# EasyEDA Pro project Chessboards.epro, board Diagonal
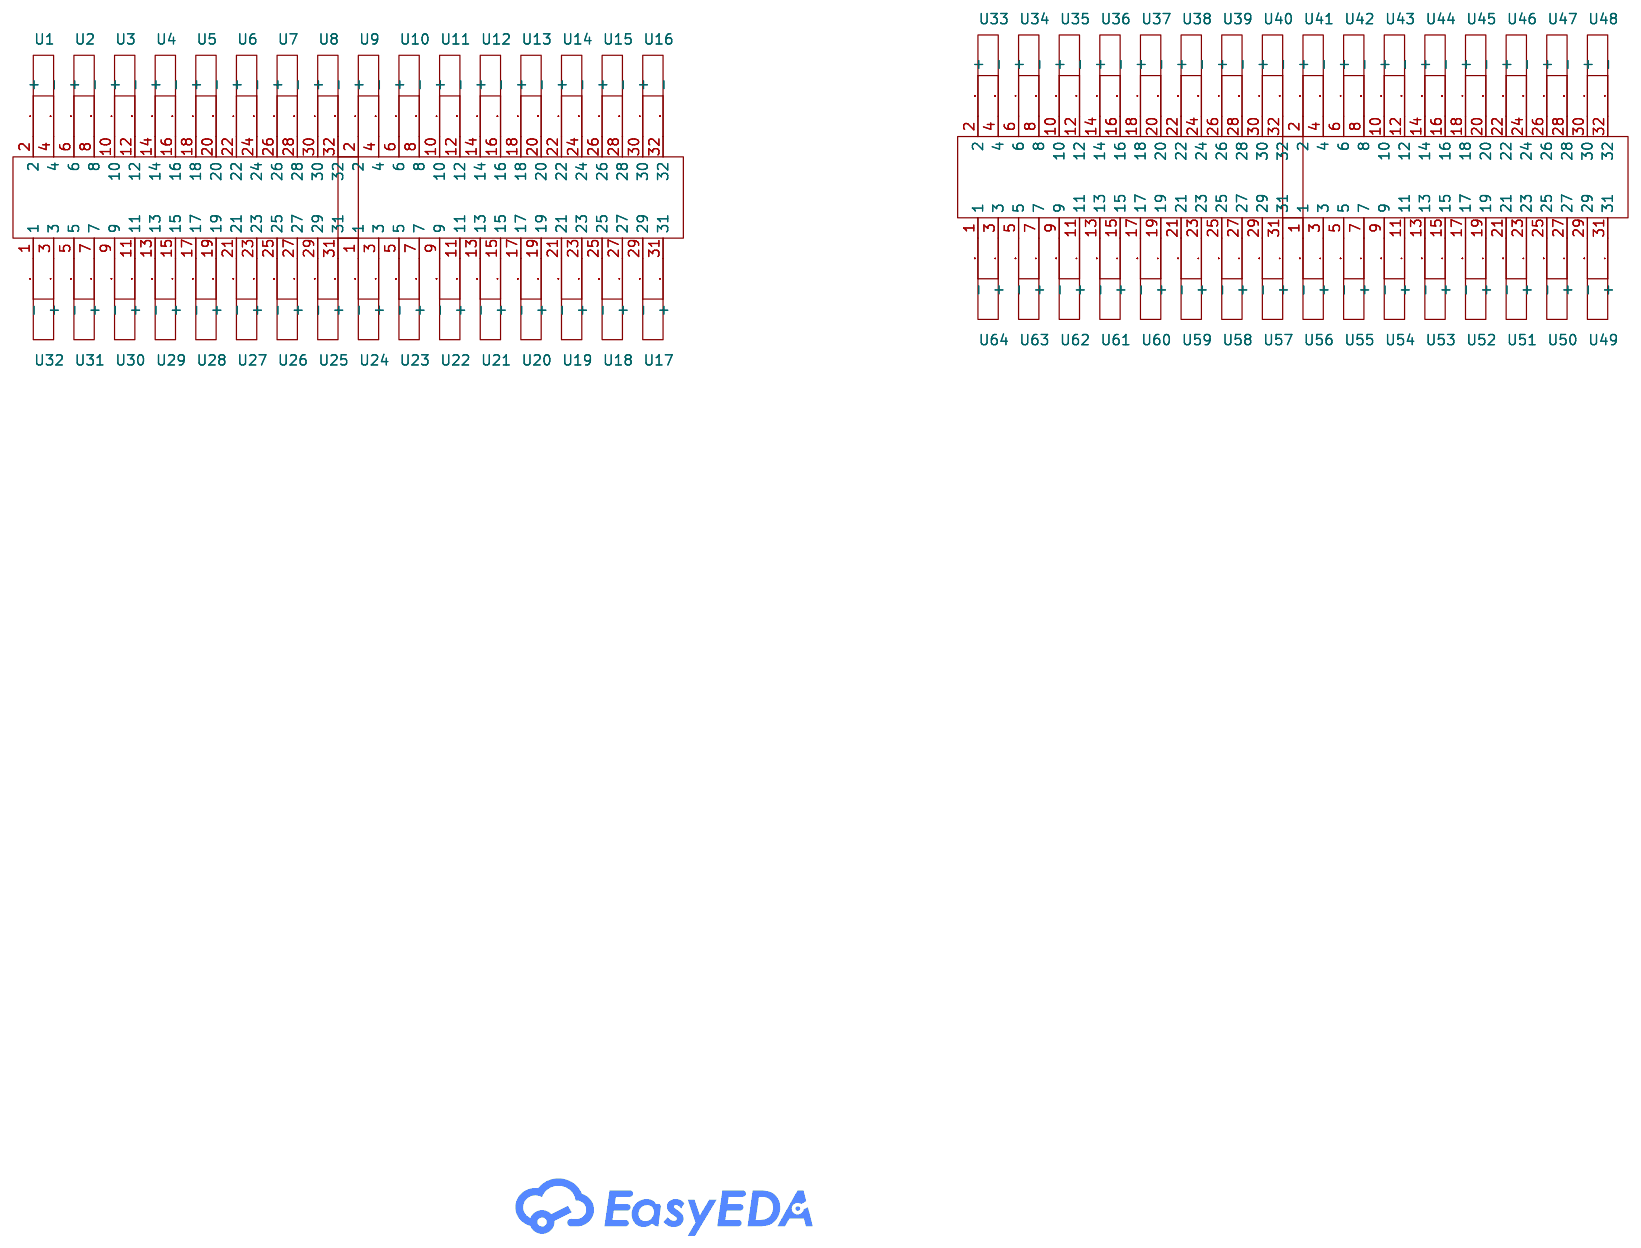
[diagram p0: schematic sheet]

Outline 503.11 x 480.86 mm; copper layers: Top Layer, Inner1, Inner2, Inner3, Inner4, Bottom Layer. Coordinates in mm from the lower left corner of the outline.
Outline path: rectangle 0,480.86 503.11,0
Stack: Top Layer 0.035mm Outer layer thickness 1oz / Dielectric1 0.0994mm 3313 RC57% 4.2mil / Inner1 0.0152mm Inner layer thickness / Dielectric2 0.55mm 0.55mm H/H No copper / Inner2 0.0152mm Inner layer thickness / Dielectric3 0.1088mm 2116 RC54% 4.9mil / Inner3 0.0152mm Inner layer thickness / Dielectric4 0.55mm 0.55mm H/H No copper / Inner4 0.0152mm Inner layer thickness / Dielectric5 0.0994mm 3313 RC57% 4.2mil / Bottom Layer 0.035mm Outer layer thickness 1oz

## Design rules (mm)
template: JLCPCB Capability(Two Layers Board)
spacing copperThickness1oz (default): track to track 0.102, other pairs 0.152 to 0.3
spacing copperThickness2oz: track to track 0.203, other pairs 0.152 to 0.3
track width copperThickness1oz (default): min 0.127, default 0.254, max 2.54
track width copperThickness2oz: min 0.203, default 0.254, max 2.54
differential pair differentialPair (default): width min 0.127, default 0.254, max 2.54; gap min 0.152, default 0.152
via viaSize (default): diameter min 0.5, default 0.61, max 10; hole min 0.3, default 0.305, max 6.3

## Placement (name value [footprint] x y rotation side)
NOREF  -  [Pad_e245]  126.29 24.62 0 top
NOREF#2  -  [Pad_e302]  338.42 455.73 0 top
NOREF#3  -  [Pad_e312]  180.75 455.73 0 top
NOREF#4  -  [Pad_e311]  134.42 455.73 0 top
NOREF#5  -  [Pad_e243]  205.15 24.62 0 top
NOREF#6  -  [Pad_e314]  259.61 455.73 0 top
NOREF#7  -  [Pad_e313]  213.28 455.73 0 top
NOREF#8  -  [Pad_e221]  47.45 24.62 0 top
NOREF#9  -  [Pad_e298]  292.09 455.73 0 top
NOREF#10  -  [Pad_e227]  330.29 24.62 0 top
NOREF#11  -  [Pad_e246]  93.78 24.62 0 top
NOREF#12  -  [Pad_e241]  283.96 24.62 0 top
NOREF#13  -  [Pad_e240]  362.8 24.62 0 top
NOREF#14  -  [Pad_e309]  55.58 455.73 0 top
NOREF#15  -  [Pad_e295]  496.12 455.73 0 top
NOREF#16  -  [Pad_e299]  370.93 455.73 0 top
NOREF#17  -  [Pad_e242]  251.47 24.62 0 top
NOREF#18  -  [Pad_e229]  487.99 24.62 0 top
NOREF#19  -  [Pad_e310]  101.91 455.73 0 top
NOREF#20  -  [Pad_e244]  172.62 24.62 0 top
NOREF#21  -  [Pad_e306]  449.79 455.73 0 top
NOREF#22  -  [Pad_e223]  441.66 24.62 0 top
NOREF#23  -  [Pad_e225]  409.13 24.62 0 top
NOREF#24  -  [Pad_e303]  417.26 455.73 0 top
REF**  -  [MountingHole:MountingHole_3.2mm_M3_DIN965]  23.62 408.54 0 top
REF**#2  -  [MountingHole:MountingHole_3.2mm_M3_DIN965]  490.76 50.87 0 top
REF**#3  -  [MountingHole:MountingHole_3.2mm_M3_DIN965]  23.62 297.16 0 top
REF**#4  -  [MountingHole:MountingHole_3.2mm_M3_DIN965]  23.62 185.78 0 top
REF**#5  -  [MountingHole:MountingHole_3.2mm_M3_DIN965]  23.62 74.4 0 top
REF**#6  -  [MountingHole:MountingHole_3.2mm_M3_DIN965]  490.76 424.39 0 top
REF**#7  -  [MountingHole:MountingHole_3.2mm_M3_DIN965]  490.76 299.88 0 top
REF**#8  -  [MountingHole:MountingHole_3.2mm_M3_DIN965]  490.76 175.38 0 top
U1  -  [Quarter]  193.77 231.24 270 top
U2  -  [Quarter]  36.08 231.24 270 top
U3  -  [Quarter]  191.51 229 90 top
U4  -  [Quarter]  349.19 229 90 top
U5  -  [Basecopper]  351.48 231.28 270 top
U6  -  [Basecopper]  467.46 229 90 top
U7  -  [HARWIN_M55-7006842R]  157.59 475.73 180 bottom
U8  -  [HARWIN_M55-7006842R]  236.43 475.73 180 bottom
U9  -  [HARWIN_M55-7006842R]  315.25 475.73 180 bottom
U10  -  [HARWIN_M55-7006842R]  394.1 475.73 180 bottom
U11  -  [HARWIN_M55-7006842R]  472.94 475.73 180 bottom
U12  -  [HARWIN_M55-7006842R]  70.62 4.62 0 bottom
U13  -  [HARWIN_M55-7006842R]  149.46 4.62 0 bottom
U14  -  [HARWIN_M55-7006842R]  228.31 4.62 0 bottom
U15  -  [HARWIN_M55-7006842R]  307.13 4.62 0 bottom
U16  -  [HARWIN_M55-7006842R]  385.97 4.62 0 bottom
U17  -  [HARWIN_M55-7006842R]  78.75 475.73 180 bottom
U18  -  [HARWIN_M55-7006842R]  464.81 4.62 0 bottom

## Footprints (pads in the part's own frame, mm; a bottom-side part is the same pattern mirrored in y, then rotated)
Basecopper
  round 0.003 hole 0.5: 1(-176.781,108.974) 2(-175.781,108.974) 3(-176.781,107.974) 4(-175.781,107.974) 5(-176.781,106.974) 6(-175.781,106.974) 7(-176.781,105.974) 8(-175.781,105.974) 9(-176.781,104.974) 10(-175.781,104.974) 11(-176.781,103.974) 12(-175.781,103.974) 13(-176.781,102.974) 14(-175.781,102.974) 15(-176.781,101.974) 16(-175.781,101.974) 17(-176.781,100.974) 18(-175.781,100.974) 19(-176.781,99.974) 20(-175.781,99.974) 21(-176.781,98.974) 22(-175.781,98.974) 23(-176.781,97.974) 24(-175.781,97.974) 25(-176.781,96.974) 26(-175.781,96.974) 27(-176.781,95.974) 28(-175.781,95.974) 29(-176.781,94.974) 30(-175.781,94.974) 32(-175.781,93.974) 33(-176.781,69.539) 34(-175.781,69.539) 35(-176.781,68.539) 36(-175.781,68.539) 37(-176.781,67.539) 38(-175.781,67.539) 39(-176.781,66.539) 40(-175.781,66.539) 41(-176.781,65.539) 42(-175.781,65.539) 43(-176.781,64.539) 44(-175.781,64.539) 45(-176.781,63.539) 46(-175.781,63.539) 47(-176.781,62.539) 48(-175.781,62.539) 49(-176.781,61.539) 50(-175.781,61.539) 51(-176.781,60.539) 52(-175.781,60.539) 53(-176.781,59.539) 54(-175.781,59.539) 55(-176.781,58.539) 56(-175.781,58.539) 57(-176.781,57.539) 58(-175.781,57.539) 59(-176.781,56.539) 60(-175.781,56.539) 61(-176.781,55.539) 62(-175.781,55.539) 64(-175.781,54.539) 65(-176.781,30.131) 66(-175.781,30.131) 67(-176.781,29.131) 68(-175.781,29.131) 69(-176.781,28.131) 70(-175.781,28.131) 71(-176.781,27.131) 72(-175.781,27.131) 73(-176.781,26.131) 74(-175.781,26.131) 75(-176.781,25.131) 76(-175.781,25.131) 77(-176.781,24.131) 78(-175.781,24.131) 79(-176.781,23.131) 80(-175.781,23.131) 81(-176.781,22.131) 82(-175.781,22.131) 83(-176.781,21.131) 84(-175.781,21.131) 85(-176.781,20.131) 86(-175.781,20.131) 87(-176.781,19.131) 88(-175.781,19.131) 89(-176.781,18.131) 90(-175.781,18.131) 91(-176.781,17.131) 92(-175.781,17.131) 93(-176.781,16.131) 94(-175.781,16.131) 96(-175.781,15.131)
  rect 0.003x0.003 hole 0.5: 31(-176.781,93.974) 63(-176.781,54.539) 95(-176.781,15.131)
HARWIN_M55-7006842R
  rect 0.8x1.1 smd: A1(20.955,-2.75) A2(19.685,-2.75) A3(18.415,-2.75) A4(17.145,-2.75) A5(15.875,-2.75) A6(14.605,-2.75) A7(13.335,-2.75) A8(12.065,-2.75) A9(10.795,-2.75) A10(9.525,-2.75) A11(8.255,-2.75) A12(6.985,-2.75) A13(5.715,-2.75) A14(4.445,-2.75) A15(3.175,-2.75) A16(1.905,-2.75) A17(0.635,-2.75) A18(-0.635,-2.75) A19(-1.905,-2.75) A20(-3.175,-2.75) A21(-4.445,-2.75) A22(-5.715,-2.75) A23(-6.985,-2.75) A24(-8.255,-2.75) A25(-9.525,-2.75) A26(-10.795,-2.75) A27(-12.065,-2.75) A28(-13.335,-2.75) A29(-14.605,-2.75) A30(-15.875,-2.75) A31(-17.145,-2.75) A32(-18.415,-2.75) A33(-19.685,-2.75) A34(-20.955,-2.75) B1(20.955,2.75) B2(19.685,2.75) B3(18.415,2.75) B4(17.145,2.75) B5(15.875,2.75) B6(14.605,2.75) B7(13.335,2.75) B8(12.065,2.75) B9(10.795,2.75) B10(9.525,2.75) B11(8.255,2.75) B12(6.985,2.75) B13(5.715,2.75) B14(4.445,2.75) B15(3.175,2.75) B16(1.905,2.75) B17(0.635,2.75) B18(-0.635,2.75) B19(-1.905,2.75) B20(-3.175,2.75) B21(-4.445,2.75) B22(-5.715,2.75) B23(-6.985,2.75) B24(-8.255,2.75) B25(-9.525,2.75) B26(-10.795,2.75) B27(-12.065,2.75) B28(-13.335,2.75) B29(-14.605,2.75) B30(-15.875,2.75) B31(-17.145,2.75) B32(-18.415,2.75) B33(-19.685,2.75) B34(-20.955,2.75)
  round 1.7 hole 1.7: None(-23.165,0) None(23.165,0)
  rect 1.2x2.7 smd: SH1(23.45,-2.45) SH2(23.45,2.45) SH3(-23.45,-2.45) SH4(-23.45,2.45)
MountingHole:MountingHole_3.2mm_M3_DIN965
  round 3.2 hole 3.2: (0,0)
Pad_e221
  round 2 hole 2: 1(0,0)
Pad_e223
  round 2 hole 2: 1(0,0)
Pad_e225
  round 2 hole 2: 2(0,0)
Pad_e227
  round 2 hole 2: 2(0,0)
Pad_e229
  round 2 hole 2: 2(0,0)
Pad_e240
  round 2 hole 2: 1(0,0)
Pad_e241
  round 2 hole 2: 1(0,0)
Pad_e242
  round 2 hole 2: 2(0,0)
Pad_e243
  round 2 hole 2: 1(0,0)
Pad_e244
  round 2 hole 2: 2(0,0)
Pad_e245
  round 2 hole 2: 1(0,0)
Pad_e246
  round 2 hole 2: 2(0,0)
Pad_e295
  round 2 hole 2: 2(0,0)
Pad_e298
  round 2 hole 2: 1(0,0)
Pad_e299
  round 2 hole 2: 1(0,0)
Pad_e302
  round 2 hole 2: 2(0,0)
Pad_e303
  round 2 hole 2: 2(0,0)
Pad_e306
  round 2 hole 2: 1(0,0)
Pad_e309
  round 2 hole 2: 1(0,0)
Pad_e310
  round 2 hole 2: 2(0,0)
Pad_e311
  round 2 hole 2: 1(0,0)
Pad_e312
  round 2 hole 2: 2(0,0)
Pad_e313
  round 2 hole 2: 1(0,0)
Pad_e314
  round 2 hole 2: 2(0,0)
Quarter
  round 0.003 hole 0.5: 1(-176.781,148.382) 2(-175.781,148.382) 3(-176.781,147.382) 4(-175.781,147.382) 5(-176.781,146.382) 6(-175.781,146.382) 7(-176.781,145.382) 8(-175.781,145.382) 9(-176.781,144.382) 10(-175.781,144.382) 11(-176.781,143.382) 12(-175.781,143.382) 13(-176.781,142.382) 14(-175.781,142.382) 15(-176.781,141.382) 16(-175.781,141.382) 17(-176.781,140.382) 18(-175.781,140.382) 19(-176.781,139.382) 20(-175.781,139.382) 21(-176.781,138.382) 22(-175.781,138.382) 23(-176.781,137.382) 24(-175.781,137.382) 25(-176.781,136.382) 26(-175.781,136.382) 27(-176.781,135.382) 28(-175.781,135.382) 29(-176.781,134.382) 30(-175.781,134.382) 32(-175.781,133.382) 33(-176.781,108.948) 34(-175.781,108.948) 35(-176.781,107.948) 36(-175.781,107.948) 37(-176.781,106.948) 38(-175.781,106.948) 39(-176.781,105.948) 40(-175.781,105.948) 41(-176.781,104.948) 42(-175.781,104.948) 43(-176.781,103.948) 44(-175.781,103.948) 45(-176.781,102.948) 46(-175.781,102.948) 47(-176.781,101.948) 48(-175.781,101.948) 49(-176.781,100.948) 50(-175.781,100.948) 51(-176.781,99.948) 52(-175.781,99.948) 53(-176.781,98.948) 54(-175.781,98.948) 55(-176.781,97.948) 56(-175.781,97.948) 57(-176.781,96.948) 58(-175.781,96.948) 59(-176.781,95.948) 60(-175.781,95.948) 61(-176.781,94.948) 62(-175.781,94.948) 64(-175.781,93.948) 65(-176.781,69.54) 66(-175.781,69.54) 67(-176.781,68.54) 68(-175.781,68.54) 69(-176.781,67.54) 70(-175.781,67.54) 71(-176.781,66.54) 72(-175.781,66.54) 73(-176.781,65.54) 74(-175.781,65.54) 75(-176.781,64.54) 76(-175.781,64.54) 77(-176.781,63.539) 78(-175.781,63.539) 79(-176.781,62.539) 80(-175.781,62.539) 81(-176.781,61.539) 82(-175.781,61.539) 83(-176.781,60.539) 84(-175.781,60.539) 85(-176.781,59.539) 86(-175.781,59.539) 87(-176.781,58.539) 88(-175.781,58.539) 89(-176.781,57.539) 90(-175.781,57.539) 91(-176.781,56.539) 92(-175.781,56.539) 93(-176.781,55.539) 94(-175.781,55.539) 96(-175.781,54.539) 97(-176.781,30.131) 98(-175.781,30.131) 99(-176.781,29.131) 100(-175.781,29.131) 101(-176.781,28.131) 102(-175.781,28.131) 103(-176.781,27.131) 104(-175.781,27.131) 105(-176.781,26.131) 106(-175.781,26.131) 107(-176.781,25.131) 108(-175.781,25.131) 109(-176.781,24.131) 110(-175.781,24.131) 111(-176.781,23.131) 112(-175.781,23.131) 113(-176.781,22.131) 114(-175.781,22.131) 115(-176.781,21.131) 116(-175.781,21.131) 117(-176.781,20.131) 118(-175.781,20.131) 119(-176.781,19.131) 120(-175.781,19.131) 121(-176.781,18.131) 122(-175.781,18.131) 123(-176.781,17.131) 124(-175.781,17.131) 125(-176.781,16.131) 126(-175.781,16.131) 128(-175.781,15.132)
  rect 0.003x0.003 hole 0.5: 31(-176.781,133.382) 63(-176.781,93.948) 95(-176.781,54.539) 127(-176.781,15.132)

## Nets

Pads without a net: NOREF 1; NOREF#2 2; NOREF#3 2; NOREF#4 1; NOREF#5 1; NOREF#6 2; NOREF#7 1; NOREF#8 1; NOREF#9 1; NOREF#10 2; NOREF#11 2; NOREF#12 1; NOREF#13 1; NOREF#14 1; NOREF#15 2; NOREF#16 1; NOREF#17 2; NOREF#18 2; NOREF#19 2; NOREF#20 2; NOREF#21 1; NOREF#22 1; NOREF#23 2; NOREF#24 2; U1 1 2 3 4 5 6 7 8 9 10 11 12 13 14 15 16 17 18 19 20 21 22 23 24 25 26 27 28 29 30 31 32 33 34 35 36 37 38 39 40 41 42 43 44 45 46 47 48 49 50 51 52 53 54 55 56 57 58 59 60 61 62 63 64 65 66 67 68 69 70 71 72 73 74 75 76 77 78 79 80 81 82 83 84 85 86 87 88 89 90 91 92 93 94 95 96 97 98 99 100 101 102 103 104 105 106 107 108 109 110 111 112 113 114 115 116 117 118 119 120 121 122 123 124 125 126 127 128; U2 1 2 3 4 5 6 7 8 9 10 11 12 13 14 15 16 17 18 19 20 21 22 23 24 25 26 27 28 29 30 31 32 33 34 35 36 37 38 39 40 41 42 43 44 45 46 47 48 49 50 51 52 53 54 55 56 57 58 59 60 61 62 63 64 65 66 67 68 69 70 71 72 73 74 75 76 77 78 79 80 81 82 83 84 85 86 87 88 89 90 91 92 93 94 95 96 97 98 99 100 101 102 103 104 105 106 107 108 109 110 111 112 113 114 115 116 117 118 119 120 121 122 123 124 125 126 127 128; U3 1 2 3 4 5 6 7 8 9 10 11 12 13 14 15 16 17 18 19 20 21 22 23 24 25 26 27 28 29 30 31 32 33 34 35 36 37 38 39 40 41 42 43 44 45 46 47 48 49 50 51 52 53 54 55 56 57 58 59 60 61 62 63 64 65 66 67 68 69 70 71 72 73 74 75 76 77 78 79 80 81 82 83 84 85 86 87 88 89 90 91 92 93 94 95 96 97 98 99 100 101 102 103 104 105 106 107 108 109 110 111 112 113 114 115 116 117 118 119 120 121 122 123 124 125 126 127 128; U4 1 2 3 4 5 6 7 8 9 10 11 12 13 14 15 16 17 18 19 20 21 22 23 24 25 26 27 28 29 30 31 32 33 34 35 36 37 38 39 40 41 42 43 44 45 46 47 48 49 50 51 52 53 54 55 56 57 58 59 60 61 62 63 64 65 66 67 68 69 70 71 72 73 74 75 76 77 78 79 80 81 82 83 84 85 86 87 88 89 90 91 92 93 94 95 96 97 98 99 100 101 102 103 104 105 106 107 108 109 110 111 112 113 114 115 116 117 118 119 120 121 122 123 124 125 126 127 128; U5 1 2 3 4 5 6 7 8 9 10 11 12 13 14 15 16 17 18 19 20 21 22 23 24 25 26 27 28 29 30 31 32 33 34 35 36 37 38 39 40 41 42 43 44 45 46 47 48 49 50 51 52 53 54 55 56 57 58 59 60 61 62 63 64 65 66 67 68 69 70 71 72 73 74 75 76 77 78 79 80 81 82 83 84 85 86 87 88 89 90 91 92 93 94 95 96; U6 1 2 3 4 5 6 7 8 9 10 11 12 13 14 15 16 17 18 19 20 21 22 23 24 25 26 27 28 29 30 31 32 33 34 35 36 37 38 39 40 41 42 43 44 45 46 47 48 49 50 51 52 53 54 55 56 57 58 59 60 61 62 63 64 65 66 67 68 69 70 71 72 73 74 75 76 77 78 79 80 81 82 83 84 85 86 87 88 89 90 91 92 93 94 95 96; U7 A1 A2 A3 A4 A5 A6 A7 A8 A9 A10 A11 A12 A13 A14 A15 A16 A17 A18 A19 A20 A21 A22 A23 A24 A25 A26 A27 A28 A29 A30 A31 A32 A33 A34 B1 B2 B3 B4 B5 B6 B7 B8 B9 B10 B11 B12 B13 B14 B15 B16 B17 B18 B19 B20 B21 B22 B23 B24 B25 B26 B27 B28 B29 B30 B31 B32 B33 B34 None SH1 SH2 SH3 SH4; U8 A1 A2 A3 A4 A5 A6 A7 A8 A9 A10 A11 A12 A13 A14 A15 A16 A17 A18 A19 A20 A21 A22 A23 A24 A25 A26 A27 A28 A29 A30 A31 A32 A33 A34 B1 B2 B3 B4 B5 B6 B7 B8 B9 B10 B11 B12 B13 B14 B15 B16 B17 B18 B19 B20 B21 B22 B23 B24 B25 B26 B27 B28 B29 B30 B31 B32 B33 B34 None SH1 SH2 SH3 SH4; U9 A1 A2 A3 A4 A5 A6 A7 A8 A9 A10 A11 A12 A13 A14 A15 A16 A17 A18 A19 A20 A21 A22 A23 A24 A25 A26 A27 A28 A29 A30 A31 A32 A33 A34 B1 B2 B3 B4 B5 B6 B7 B8 B9 B10 B11 B12 B13 B14 B15 B16 B17 B18 B19 B20 B21 B22 B23 B24 B25 B26 B27 B28 B29 B30 B31 B32 B33 B34 None SH1 SH2 SH3 SH4; U10 A1 A2 A3 A4 A5 A6 A7 A8 A9 A10 A11 A12 A13 A14 A15 A16 A17 A18 A19 A20 A21 A22 A23 A24 A25 A26 A27 A28 A29 A30 A31 A32 A33 A34 B1 B2 B3 B4 B5 B6 B7 B8 B9 B10 B11 B12 B13 B14 B15 B16 B17 B18 B19 B20 B21 B22 B23 B24 B25 B26 B27 B28 B29 B30 B31 B32 B33 B34 None SH1 SH2 SH3 SH4; U11 A1 A2 A3 A4 A5 A6 A7 A8 A9 A10 A11 A12 A13 A14 A15 A16 A17 A18 A19 A20 A21 A22 A23 A24 A25 A26 A27 A28 A29 A30 A31 A32 A33 A34 B1 B2 B3 B4 B5 B6 B7 B8 B9 B10 B11 B12 B13 B14 B15 B16 B17 B18 B19 B20 B21 B22 B23 B24 B25 B26 B27 B28 B29 B30 B31 B32 B33 B34 None SH1 SH2 SH3 SH4; U12 A1 A2 A3 A4 A5 A6 A7 A8 A9 A10 A11 A12 A13 A14 A15 A16 A17 A18 A19 A20 A21 A22 A23 A24 A25 A26 A27 A28 A29 A30 A31 A32 A33 A34 B1 B2 B3 B4 B5 B6 B7 B8 B9 B10 B11 B12 B13 B14 B15 B16 B17 B18 B19 B20 B21 B22 B23 B24 B25 B26 B27 B28 B29 B30 B31 B32 B33 B34 None SH1 SH2 SH3 SH4; U13 A1 A2 A3 A4 A5 A6 A7 A8 A9 A10 A11 A12 A13 A14 A15 A16 A17 A18 A19 A20 A21 A22 A23 A24 A25 A26 A27 A28 A29 A30 A31 A32 A33 A34 B1 B2 B3 B4 B5 B6 B7 B8 B9 B10 B11 B12 B13 B14 B15 B16 B17 B18 B19 B20 B21 B22 B23 B24 B25 B26 B27 B28 B29 B30 B31 B32 B33 B34 None SH1 SH2 SH3 SH4; U14 A1 A2 A3 A4 A5 A6 A7 A8 A9 A10 A11 A12 A13 A14 A15 A16 A17 A18 A19 A20 A21 A22 A23 A24 A25 A26 A27 A28 A29 A30 A31 A32 A33 A34 B1 B2 B3 B4 B5 B6 B7 B8 B9 B10 B11 B12 B13 B14 B15 B16 B17 B18 B19 B20 B21 B22 B23 B24 B25 B26 B27 B28 B29 B30 B31 B32 B33 B34 None SH1 SH2 SH3 SH4; U15 A1 A2 A3 A4 A5 A6 A7 A8 A9 A10 A11 A12 A13 A14 A15 A16 A17 A18 A19 A20 A21 A22 A23 A24 A25 A26 A27 A28 A29 A30 A31 A32 A33 A34 B1 B2 B3 B4 B5 B6 B7 B8 B9 B10 B11 B12 B13 B14 B15 B16 B17 B18 B19 B20 B21 B22 B23 B24 B25 B26 B27 B28 B29 B30 B31 B32 B33 B34 None SH1 SH2 SH3 SH4; U16 A1 A2 A3 A4 A5 A6 A7 A8 A9 A10 A11 A12 A13 A14 A15 A16 A17 A18 A19 A20 A21 A22 A23 A24 A25 A26 A27 A28 A29 A30 A31 A32 A33 A34 B1 B2 B3 B4 B5 B6 B7 B8 B9 B10 B11 B12 B13 B14 B15 B16 B17 B18 B19 B20 B21 B22 B23 B24 B25 B26 B27 B28 B29 B30 B31 B32 B33 B34 None SH1 SH2 SH3 SH4; U17 A1 A2 A3 A4 A5 A6 A7 A8 A9 A10 A11 A12 A13 A14 A15 A16 A17 A18 A19 A20 A21 A22 A23 A24 A25 A26 A27 A28 A29 A30 A31 A32 A33 A34 B1 B2 B3 B4 B5 B6 B7 B8 B9 B10 B11 B12 B13 B14 B15 B16 B17 B18 B19 B20 B21 B22 B23 B24 B25 B26 B27 B28 B29 B30 B31 B32 B33 B34 None SH1 SH2 SH3 SH4; U18 A1 A2 A3 A4 A5 A6 A7 A8 A9 A10 A11 A12 A13 A14 A15 A16 A17 A18 A19 A20 A21 A22 A23 A24 A25 A26 A27 A28 A29 A30 A31 A32 A33 A34 B1 B2 B3 B4 B5 B6 B7 B8 B9 B10 B11 B12 B13 B14 B15 B16 B17 B18 B19 B20 B21 B22 B23 B24 B25 B26 B27 B28 B29 B30 B31 B32 B33 B34 None SH1 SH2 SH3 SH4

## Via types
v1: diameter 0.8, hole 0.4, Top Layer to Bottom Layer, 2284 vias
v2: diameter 0.61, hole 0.305, Top Layer to Bottom Layer, 770 vias

## Routing (per net, layer and track width the routed paths; a pad name or vN(x,y) marks a point on that pad's centre or on a via; arc(x,y) is an arc through that point)
(no net): length 61253.6
  Inner3 w0.254: 378.77,469.92 378.77,442.04 382.9,437.91 382.9,434.71 382.1,433.9 377.47,433.9 372.51,428.95 ; 208.84,38.32 211.42,35.75 216.5,35.75 219.24,33.01 219.24,26.17 220.62,24.8 220.62,10.16 ; v1(53.22,408.02) 53.22,408.52 56.76,412.06 56.76,429.05 ; 249.36,40.53 244.57,35.74 241.8,35.74 241,34.94 241,31 245.13,26.87 245.13,10.19 ; 170.51,40.56 170.51,48.81 173.41,51.71 173.41,52.21 ; U1.111 216.9,408.52 216.58,408.84 216.58,428.16 ; 407.73,40.26 407.73,47.52 411.92,51.71 U6.61 ; 376.79,427.18 379.24,429.63 383.87,429.63 387.18,432.94 387.18,435.15 394.06,442.04 394.06,469.92 ; 288.76,38.79 288.76,48.81 291.66,51.71 v1(291.66,52.21) ; 412.27,442.48 412.27,410.82 410.02,408.57 U5.55 ; 336.23,439.22 336.22,443.62 331.46,448.37 328.71,448.37 327.9,449.17 327.9,465.16 332.03,469.29 332.03,469.85 ; 336.23,439.22 336.23,411.42 339.12,408.52 339.12,408.02 ; 336.23,439.22 336.23,440.94 ; 335.87,439.22 335.87,410.78 338.12,408.52 338.12,408.02 ; 335.87,439.22 335.87,440.94 ; 335.87,439.22 335.86,443.47 331.32,448.01 328.56,448.01 327.55,449.03 327.55,466.08 330.76,469.29 330.76,469.85 ; 446.43,38.79 446.43,48.81 449.33,51.71 v1(449.33,52.21) ; 206,37.14 206,47.5 201.81,51.68 201.81,52.19 ; 332.66,442.14 329.99,444.81 327.23,444.81 324.34,447.7 324.34,464.24 319.29,469.29 319.29,469.85 ; 145.6,10.19 145.6,24.82 141.47,28.95 141.47,33.48 138.1,36.84 133.02,36.84 131.07,38.79 ; 296.82,427.57 296.82,411.42 299.72,408.52 U1.39 ; U1.85 253.31,408.52 254.92,410.13 254.92,442.58 ; 159.92,10.22 159.92,26.9 160.38,27.36 160.38,35.7 162.23,37.55 165,37.55 168.74,41.29 ; 373.48,52.21 373.48,51.71 368.65,46.88 368.65,39.23 ; v2(87.89,469.85) 87.89,469.29 89.27,467.91 89.27,448.29 91.32,446.23 94.08,446.23 97.58,442.73 97.59,439.22 ; 396.91,469.89 396.91,469.33 402.88,463.37 402.88,447.6 405.98,444.5 408.74,444.5 411.2,442.04 ; 365.48,52.21 365.48,51.71 365.8,51.39 365.8,38.05 ; 209.56,38.62 209.56,49.43 211.81,51.68 211.81,52.19 ; v2(70.58,10.19) 70.58,24.82 63.69,31.71 63.69,33.92 59.7,37.91 54.62,37.91 53.3,39.23 53.3,46.88 58.13,51.71 U3.31 ; 59.61,427.87 59.61,410.13 61.22,408.52 U2.107 ; 56.05,429.34 61.63,434.93 66.26,434.93 66.31,434.98 66.31,435.23 59.56,441.99 v2(59.56,469.88) ; 328.92,40.26 323.71,35.06 320.94,35.06 320.55,34.67 320.55,32.86 326.52,26.9 326.52,10.22 ; 218.71,427.28 218.71,412.71 222.9,408.52 U1.99 ; 246.15,41.85 246.15,48.78 243.25,51.68 243.25,52.19 ; 246.15,41.85 243.25,38.95 240.48,38.95 237.79,36.26 237.79,31 233.66,26.87 233.66,10.19 ; 246.15,41.85 246.16,41.86 ; 407.74,40.26 402.54,35.06 399.77,35.06 399.38,34.67 399.38,32.86 405.35,26.9 v2(405.35,10.22) ; 255.63,439.22 255.63,408.84 255.31,408.52 U1.81 ; 255.63,439.22 255.62,442.88 251.91,446.59 249.15,446.59 247.3,448.44 247.3,468.83 246.85,469.29 v2(246.85,469.85) ; 255.63,439.22 255.63,440.94 ; 218,427.57 218,411.42 220.9,408.52 U1.103 ; 207.81,52.19 207.81,51.68 208.13,51.36 208.13,38.03 ; 444.29,37.91 447.49,34.71 452.57,34.71 454.69,32.59 454.69,26.2 453.31,24.82 453.31,10.19 ; 453.13,428.2 457.05,432.12 461.67,432.12 463.52,433.97 463.52,441.57 463.98,442.03 463.98,469.92 ; v2(87.45,10.22) 87.45,26.9 83.31,31.03 83.31,34.96 84.12,35.77 86.89,35.77 91.68,40.56 ; 210.27,38.91 210.27,48.14 213.81,51.68 213.81,52.19 ; 90.25,41.15 86.3,37.19 83.53,37.19 81.89,35.55 81.89,27.36 82.35,26.9 v2(82.35,10.22) ; 168.37,41.43 164.85,37.9 162.08,37.9 160.02,35.85 160.02,28.27 158.64,26.9 158.64,10.22 ; 168.37,41.43 168.37,50.74 167.41,51.71 167.41,52.21 ; 168.37,41.43 168.37,41.4 ; 168.37,41.43 168.38,41.44 ; 162.47,10.22 162.47,26.9 161.09,28.27 161.09,35.41 162.52,36.84 165.29,36.84 169.45,41 ; 162.47,10.22 v2(162.46,10.21) ; 162.47,10.22 162.5,10.25 ; 142.19,469.9 142.19,442.02 146.32,437.89 146.32,434.69 145.52,433.88 140.89,433.88 135.93,428.93 ; 88.82,41.73 88.82,49.45 86.56,51.71 86.56,52.21 ; 88.82,41.73 88.83,41.74 ; 88.82,41.73 85.71,38.62 82.94,38.62 80.47,36.14 80.47,30.11 77.25,26.9 v2(77.25,10.22) ; U3.23 54.13,51.71 51.87,49.45 51.87,38.64 54.03,36.49 59.11,36.49 62.27,33.33 62.27,28.03 65.48,24.82 v2(65.48,10.19) ; 298.19,10.19 298.19,24.82 297.73,25.28 297.73,32.89 295.19,35.42 290.11,35.42 287.33,38.2 ; 328.21,469.85 328.21,469.29 326.83,467.91 326.83,448.73 328.26,447.3 331.02,447.3 335.15,443.17 335.16,439.22 ; v2(374.47,10.19) 374.47,24.82 375.84,26.2 375.84,32.59 373.73,34.71 368.65,34.71 365.45,37.91 ; 174.35,469.87 174.35,469.31 170.22,465.18 170.22,449.2 171.02,448.39 173.78,448.39 178.53,443.64 178.54,439.25 ; 320.09,52.21 320.09,51.71 324.28,47.52 324.28,42.17 ; 131.97,52.21 131.97,51.71 130.36,50.1 130.36,38.5 ; 315.16,469.88 315.16,441.99 308.28,435.11 308.28,432.89 304.97,429.59 300.35,429.59 297.89,427.13 ; 403.82,41.87 400.92,38.97 398.15,38.97 395.46,36.29 395.46,31.03 391.33,26.9 v2(391.33,10.22) ; 403.82,41.87 403.82,48.81 400.92,51.71 U6.39 ; 403.82,41.87 403.83,41.88 ; 215.51,428.61 220.05,433.15 224.68,433.15 225.9,434.37 225.9,439.7 223.61,441.99 v2(223.61,469.88) ; 410.85,441.89 410.85,413.4 406.02,408.57 U5.63 ; 446.78,38.94 448.52,37.2 453.6,37.2 457.18,33.62 457.18,29.87 462.23,24.82 462.23,10.19 ; 408.1,40.11 402.69,34.7 399.92,34.7 399.74,34.52 399.74,33.78 406.62,26.9 v2(406.62,10.22) ; v2(377.01,10.19) 377.01,24.82 376.55,25.28 376.55,32.89 374.02,35.42 368.94,35.42 366.16,38.2 ; 365.09,37.76 368.5,34.35 373.58,34.35 375.49,32.44 375.49,27.12 373.19,24.82 v2(373.19,10.19) ; v1(329.12,408.02) 329.12,408.52 332.67,412.06 332.67,442.14 ; 325.35,41.73 325.35,49.45 323.09,51.71 323.09,52.21 ; 325.35,41.73 322.24,38.62 319.47,38.62 316.99,36.14 316.99,30.11 313.78,26.9 313.78,10.22 ; 325.35,41.73 325.36,41.74 ; 245.08,42.29 245.08,46.85 240.25,51.68 240.25,52.19 ; 245.08,42.29 242.8,40.01 240.03,40.01 236.72,36.71 236.72,33.75 229.84,26.87 229.84,10.19 ; 245.08,42.29 245.09,42.3 ; U4.85 289.66,51.71 288.05,50.1 288.05,38.5 ; 403.1,42.17 400.62,39.69 397.85,39.69 394.75,36.59 394.75,32.86 388.79,26.9 v2(388.79,10.22) ; 403.1,42.17 403.1,47.52 398.92,51.71 U6.35 ; 403.1,42.17 403.12,42.18 ; 363.31,37.02 363.31,46.88 358.48,51.71 v1(358.48,52.21) ; 135.58,429.07 140.75,434.24 145.37,434.24 145.97,434.84 145.97,436.97 140.92,442.02 140.92,469.9 ; U6.43 402.92,51.71 404.53,50.1 404.53,41.58 ; 289.83,39.23 289.83,46.88 294.66,51.71 v1(294.66,52.21) ; 450.28,429.38 450.28,413.39 445.45,408.56 445.45,408.06 ; 166.95,42.02 164.26,39.33 161.49,39.33 158.6,36.44 158.6,31.94 153.55,26.9 153.55,10.22 ; 166.95,42.02 166.95,48.17 163.41,51.71 163.41,52.21 ; 166.95,42.02 166.96,42.03 ; 219.07,427.13 221.53,429.59 226.16,429.59 229.46,432.89 229.46,435.11 236.35,441.99 v2(236.35,469.88) ; 448.45,408.06 448.45,408.56 451.35,411.46 451.35,428.94 ; v2(385.93,10.19) 385.93,24.82 379.05,31.71 379.05,33.92 375.05,37.91 369.97,37.91 368.65,39.23 ; 231.11,10.19 231.11,26.87 237.08,32.84 237.08,36.56 240.18,39.66 242.95,39.66 245.43,42.14 ; 405.25,41.29 401.51,37.55 398.74,37.55 396.89,35.7 396.89,27.36 396.43,26.9 v2(396.43,10.22) ; 205.81,52.19 205.81,51.68 207.42,50.07 207.42,37.73 ; v1(136.97,52.21) 136.97,51.71 132.14,46.88 132.14,39.23 ; 130.36,38.5 132.72,36.13 137.81,36.13 140.76,33.18 140.76,27.12 143.05,24.82 143.05,10.19 ; 98.62,408.02 98.62,408.52 98.3,408.84 98.3,439.22 ; 412.99,439.27 412.99,440.99 ; 412.99,439.27 412.98,442.78 409.48,446.28 406.72,446.28 404.66,448.33 404.66,467.96 403.28,469.33 403.28,469.89 ; 412.99,439.27 412.99,409.53 412.02,408.57 U5.51 ; 167.31,41.87 167.31,48.81 164.41,51.71 164.41,52.21 ; 167.31,41.87 167.32,41.88 ; 167.31,41.87 164.41,38.97 161.64,38.97 158.95,36.29 158.95,31.03 154.82,26.9 154.82,10.22 ; 291.82,10.19 291.82,24.82 295.95,28.95 295.95,32.15 294.46,33.64 289.38,33.64 285.55,37.46 ; v2(395.16,10.22) 395.16,26.9 396.53,28.27 396.53,35.85 398.59,37.9 401.36,37.9 404.88,41.43 ; 100.08,439.22 100.08,412.06 103.62,408.52 103.62,408.02 ; 100.08,439.22 100.08,440.94 ; 100.08,439.22 100.07,443.76 95.11,448.73 92.35,448.73 91.76,449.32 91.76,464.24 96.81,469.29 v2(96.81,469.85) ; 323.11,469.85 323.11,469.29 325.41,466.99 325.41,448.14 327.67,445.88 330.43,445.88 333.72,442.58 ; v2(366.82,10.19) 366.82,24.82 373.58,31.58 373.58,31.83 372.84,32.57 367.76,32.57 363.31,37.02 ; U6.67 438.33,51.71 442.51,47.52 442.51,37.17 ; 241.34,10.25 241.31,10.22 ; 241.31,10.22 241.31,26.87 239.93,28.25 239.93,35.38 241.36,36.81 244.13,36.81 248.29,40.97 ; 241.31,10.22 241.31,10.19 ; 177.83,439.25 177.82,443.35 173.49,447.68 170.73,447.68 169.51,448.91 169.51,467.02 171.8,469.31 171.8,469.87 ; 177.83,439.25 177.83,440.97 ; 177.83,439.25 177.83,410.16 179.44,408.55 179.44,408.04 ; v2(228.7,469.88) 228.7,441.99 227.33,440.61 227.33,433.78 225.27,431.72 220.64,431.72 216.94,428.01 ; 403.46,42.02 403.47,42.03 ; 403.46,42.02 403.46,48.17 399.92,51.71 U6.37 ; 403.46,42.02 400.77,39.33 398,39.33 395.11,36.44 395.11,31.94 390.06,26.9 v2(390.06,10.22) ; v2(76.12,469.88) 76.12,441.99 71.07,436.94 71.07,433.19 68.18,430.3 63.55,430.3 60.68,427.43 ; 214.09,429.19 214.09,412.71 209.9,408.52 v1(209.9,408.02) ; 175.44,408.04 175.44,408.55 176.41,409.51 176.41,439.25 ; 170.15,40.7 170.15,49.45 172.41,51.71 172.41,52.21 ; v2(54.02,10.19) 54.02,24.82 59.06,29.87 59.06,32 57.78,33.28 52.7,33.28 48.67,37.32 48.67,48.17 45.13,51.71 v1(45.13,52.21) ; 373.23,428.65 377.77,433.19 382.39,433.19 383.62,434.41 383.62,439.74 381.32,442.04 381.32,469.92 ; v1(452.33,52.21) 452.33,51.71 447.5,46.88 447.5,39.23 ; 289.27,10.19 289.27,24.82 295.24,30.79 295.24,31.85 294.16,32.93 289.08,32.93 284.84,37.17 ; 332.31,441.99 332.31,412.71 328.12,408.52 v1(328.12,408.02) ; 454.91,427.47 457.79,430.34 462.41,430.34 465.3,433.23 465.3,436.98 470.35,442.03 470.35,469.92 ; 366.16,38.2 366.16,51.39 366.48,51.71 366.48,52.21 ; v2(378.29,10.19) 378.29,24.82 376.91,26.2 376.91,33.03 374.17,35.78 369.09,35.78 366.51,38.35 ; 406.68,40.7 402.1,36.12 399.33,36.12 398.31,35.11 398.31,30.11 401.53,26.9 v2(401.53,10.22) ; 176.44,408.04 176.44,408.55 176.76,408.87 176.76,439.25 ; 457.61,469.92 457.61,442.03 461.74,437.9 461.74,434.7 460.94,433.9 456.31,433.9 451.35,428.94 ; 135.57,429.07 135.57,412.09 132.03,408.55 132.03,408.04 ; 370.48,52.21 370.48,51.71 367.58,48.81 367.58,38.79 ; 60.32,427.57 63.4,430.65 68.03,430.65 70.71,433.34 70.71,437.86 74.84,441.99 v2(74.84,469.88) ; 363.67,37.17 363.67,47.52 359.48,51.71 v1(359.48,52.21) ; 208.81,52.19 208.81,51.68 208.49,51.36 208.49,38.18 ; U4.81 287.66,51.71 287.33,51.39 287.33,38.2 ; 131.59,10.19 131.59,24.82 137.55,30.79 137.55,31.85 136.48,32.93 131.4,32.93 127.16,37.17 ; 89.53,41.43 86,37.9 83.23,37.9 81.18,35.85 81.18,28.27 79.8,26.9 v2(79.8,10.22) ; 89.53,41.43 89.53,50.74 88.56,51.71 88.56,52.21 ; 89.53,41.43 89.54,41.44 ; 89.53,41.43 89.53,41.4 ; 450.99,429.09 450.99,412.11 447.45,408.56 447.45,408.06 ; U1.105 219.9,408.52 217.65,410.78 217.65,427.72 ; 126.8,37.02 126.8,46.88 121.97,51.71 121.97,52.21 ; v2(229.98,469.88) 229.98,441.99 227.68,439.7 227.68,433.63 225.42,431.37 220.79,431.37 217.29,427.87 ; v2(98.08,469.85) 98.08,469.29 92.11,463.32 92.11,449.47 92.5,449.08 95.26,449.08 100.43,443.91 100.44,439.22 ; 404.17,41.73 404.18,41.74 ; 404.17,41.73 401.06,38.62 398.29,38.62 395.82,36.14 395.82,30.11 392.61,26.9 v2(392.61,10.22) ; 404.17,41.73 404.17,49.45 401.92,51.71 U6.41 ; 60.32,427.57 60.32,411.42 63.22,408.52 U2.103 ; U1.49 294.72,408.52 295.04,408.84 295.04,428.31 ; 87.75,42.17 87.76,42.18 ; 87.75,42.17 87.75,47.52 83.56,51.71 83.56,52.21 ; 87.75,42.17 85.27,39.69 82.5,39.69 79.4,36.59 79.4,32.86 73.43,26.9 v2(73.43,10.22) ; 127.87,37.46 127.87,48.81 124.97,51.71 124.97,52.21 ; 295.75,428.01 299.46,431.72 304.09,431.72 306.14,433.78 306.14,440.61 307.52,441.99 307.52,469.88 ; 367.58,38.79 369.53,36.84 374.61,36.84 377.98,33.48 377.98,28.95 382.11,24.82 v2(382.11,10.19) ; U5.35 420.02,408.57 415.83,412.75 415.83,439.27 ; v2(369.37,10.19) 369.37,24.82 374.42,29.87 374.42,32 373.14,33.28 368.06,33.28 364.02,37.32 ; U1.73 259.31,408.52 257.05,410.78 257.05,439.22 ; U5.71 378.61,408.57 375.71,411.47 375.71,427.62 ; U1.69 261.31,408.52 257.76,412.06 257.76,439.22 ; 250.42,40.09 250.42,46.85 255.25,51.68 255.25,52.19 ; 333.31,469.85 333.31,469.29 328.26,464.24 328.26,449.32 328.85,448.73 331.61,448.73 336.57,443.76 336.58,439.22 ; 166.41,52.21 166.41,51.71 168.02,50.1 168.02,41.58 ; v2(69.75,469.88) 69.75,441.99 69.29,441.53 69.29,433.93 67.44,432.08 62.81,432.08 58.9,428.16 ; 334.44,439.22 334.44,408.84 334.12,408.52 334.12,408.02 ; 334.44,439.22 334.44,442.88 330.73,446.59 327.97,446.59 326.12,448.44 326.12,468.83 325.66,469.29 325.66,469.85 ; 334.44,439.22 334.44,440.94 ; 130.03,408.04 130.03,408.55 134.86,413.38 134.86,429.37 ; 293.09,10.19 293.09,24.82 296.3,28.03 296.3,32.3 294.6,34 289.52,34 285.91,37.61 ; v2(81.08,10.22) 81.08,26.9 81.53,27.36 81.53,35.7 83.38,37.55 86.15,37.55 89.9,41.29 ; 297.88,427.13 297.88,413.35 302.72,408.52 U1.33 ; 129.29,38.05 132.28,35.06 137.36,35.06 139.69,32.74 139.69,25.28 139.23,24.82 139.23,10.19 ; 136.29,428.78 136.29,410.8 134.03,408.55 134.03,408.04 ; 138.37,469.9 138.37,442.02 145.13,435.26 145.13,435.01 145.08,434.95 140.45,434.95 134.87,429.37 ; v1(293.66,52.21) 293.66,51.71 289.47,47.52 289.47,39.09 ; U2.111 59.22,408.52 58.89,408.84 58.89,428.16 ; 87.39,42.31 87.39,46.88 82.56,51.71 82.56,52.21 ; 87.39,42.31 87.41,42.33 ; 87.39,42.31 85.12,40.04 82.35,40.04 79.04,36.73 79.04,33.78 72.16,26.9 v2(72.16,10.22) ; 89.17,41.58 89.19,41.59 ; 89.17,41.58 85.86,38.26 83.09,38.26 80.82,36 80.82,29.19 78.53,26.9 v2(78.53,10.22) ; 89.17,41.58 89.17,50.1 87.56,51.71 87.56,52.21 ; 209.15,10.16 209.15,24.8 215.91,31.55 215.91,31.81 215.17,32.55 210.09,32.55 205.64,37 ; 129.29,38.05 129.29,51.39 128.97,51.71 128.97,52.21 ; 99.73,439.22 99.73,440.94 ; 99.73,439.22 99.73,411.42 102.62,408.52 102.62,408.02 ; 99.73,439.22 99.72,443.62 94.96,448.37 92.21,448.37 91.4,449.17 91.4,465.16 95.53,469.29 v2(95.53,469.85) ; 285.19,37.32 289.23,33.28 294.31,33.28 295.59,32 295.59,29.87 290.54,24.82 290.54,10.19 ; 249.72,40.38 244.72,35.39 241.95,35.39 241.35,34.79 241.35,31.92 246.4,26.87 246.4,10.19 ; 367.23,38.64 367.23,49.45 369.48,51.71 369.48,52.21 ; 97.95,439.22 97.94,442.88 94.23,446.59 91.47,446.59 89.62,448.44 89.62,468.83 89.16,469.29 v2(89.16,469.85) ; 97.95,439.22 97.95,440.94 ; 97.95,439.22 97.95,408.84 97.62,408.52 97.62,408.02 ; U1.117 213.9,408.52 215.51,410.13 215.51,428.61 ; 159.06,469.87 159.06,469.31 165.95,462.43 165.95,447.43 169.25,444.12 172.01,444.12 174.26,441.87 ; U1.119 212.9,408.52 215.15,410.78 215.15,428.75 ; 377.5,469.92 377.5,442.04 382.55,436.99 382.55,434.86 381.95,434.26 377.33,434.26 372.16,429.09 ; 258.48,439.22 258.48,440.94 ; 258.48,439.22 258.47,444.06 253.09,449.44 250.33,449.44 250.15,449.62 250.15,462.4 257.04,469.29 v2(257.04,469.85) ; 258.48,439.22 258.48,413.35 263.31,408.52 U1.65 ; 407.39,40.41 402.39,35.41 399.62,35.41 399.02,34.82 399.02,31.94 404.07,26.9 v2(404.07,10.22) ; 59.97,427.72 63.26,431.01 67.88,431.01 70.36,433.48 70.36,438.78 73.57,441.99 v2(73.57,469.88) ; 336.12,408.02 336.12,408.52 335.16,409.49 335.16,439.22 ; 149.84,469.9 149.84,442.02 148.46,440.64 148.46,433.81 146.4,431.75 141.78,431.75 138.07,428.04 ; 442.15,37.02 446.6,32.57 451.69,32.57 452.42,31.83 452.42,31.58 445.67,24.82 445.67,10.19 ; 335.85,469.85 335.85,469.29 328.97,462.4 328.97,449.62 329.15,449.44 331.91,449.44 337.28,444.06 337.29,439.22 ; 460.16,469.92 460.16,442.03 462.46,439.74 462.46,434.41 461.23,433.19 456.61,433.19 452.06,428.65 ; 452.42,428.5 456.75,432.83 461.38,432.83 462.81,434.26 462.81,440.66 461.43,442.03 461.43,469.92 ; 317.6,10.22 317.6,26.9 318.06,27.36 318.06,35.7 319.91,37.55 322.68,37.55 326.42,41.29 ; 100.62,408.02 100.62,408.52 99.01,410.13 99.01,439.22 ; U3.25 55.13,51.71 52.23,48.81 52.23,38.79 54.18,36.84 59.26,36.84 62.62,33.48 62.62,28.95 66.76,24.82 v2(66.76,10.19) ; 257.05,439.22 257.04,443.47 252.5,448.01 249.74,448.01 248.73,449.03 248.73,466.08 251.94,469.29 v2(251.94,469.85) ; 257.05,439.22 257.05,440.94 ; 139.13,427.6 139.13,411.45 142.03,408.55 142.03,408.04 ; 256.34,439.22 256.33,443.17 252.21,447.3 249.45,447.3 248.02,448.73 248.02,467.91 249.39,469.29 v2(249.39,469.85) 249.43,469.81 ; 256.34,439.22 256.34,409.49 257.31,408.52 U1.77 ; 256.34,439.22 256.34,440.94 ; 366.87,38.5 366.87,50.1 368.48,51.71 368.48,52.21 ; 335.51,439.22 335.51,440.94 ; 335.51,439.22 335.51,410.13 337.12,408.52 337.12,408.02 ; 335.51,439.22 335.5,443.32 331.17,447.66 328.41,447.66 327.19,448.88 327.19,466.99 329.48,469.29 329.48,469.85 ; 402.75,42.31 402.76,42.33 ; 402.75,42.31 402.75,46.88 397.92,51.71 U6.33 ; 402.75,42.31 400.47,40.04 397.7,40.04 394.4,36.73 394.4,33.78 387.51,26.9 v2(387.51,10.22) ; 451.71,428.79 456.46,433.54 461.09,433.54 462.1,434.56 462.1,438.82 458.89,442.03 458.89,469.92 ; 151,10.22 151,26.9 157.89,33.78 157.89,36.73 161.19,40.04 163.96,40.04 166.24,42.31 ; 466.53,469.92 466.53,442.03 464.24,439.74 464.24,433.67 461.97,431.41 457.34,431.41 453.84,427.91 ; 366.52,38.35 366.52,50.74 367.48,51.71 367.48,52.21 ; 364.38,37.46 364.38,48.81 361.48,51.71 v1(361.48,52.21) ; 445.36,38.35 447.93,35.78 453.01,35.78 455.75,33.03 455.75,26.2 457.13,24.82 457.13,10.19 ; 336.58,439.22 336.58,440.94 ; 336.58,439.22 336.58,412.06 340.12,408.52 340.12,408.02 ; 210.63,39.06 210.63,47.5 214.81,51.68 214.81,52.19 ; v2(86.61,469.85) 86.61,469.29 88.91,466.99 88.91,448.14 91.17,445.88 93.93,445.88 97.23,442.58 ; v2(69.3,10.19) 69.3,24.82 63.34,30.79 63.34,33.77 59.55,37.56 54.47,37.56 52.94,39.09 52.94,47.52 57.13,51.71 U3.29 ; 136.03,408.04 136.03,408.55 137,409.51 137,428.48 ; 325.7,41.58 322.38,38.26 319.61,38.26 317.35,36 317.35,29.19 315.05,26.9 315.05,10.22 ; 325.7,41.58 325.7,50.1 324.09,51.71 324.09,52.21 ; 325.7,41.58 325.71,41.59 ; 246.86,41.55 246.86,50.07 245.25,51.68 245.25,52.19 ; 246.86,41.55 246.87,41.56 ; 246.86,41.55 243.54,38.24 240.77,38.24 238.5,35.97 238.5,29.16 236.21,26.87 236.21,10.19 ; U3.17 51.13,51.71 50.81,51.39 50.81,38.2 53.59,35.42 58.67,35.42 61.2,32.89 61.2,25.28 61.66,24.82 v2(61.66,10.19) ; 404.88,41.43 404.88,41.4 ; 404.88,41.43 404.9,41.44 ; 404.88,41.43 404.88,50.74 403.92,51.71 U6.45 ; 257.76,439.22 257.76,440.94 ; 257.76,439.22 257.76,443.76 252.8,448.73 250.04,448.73 249.44,449.32 249.44,464.24 254.49,469.29 v2(254.49,469.85) ; 247.93,41.12 247.93,51.36 248.25,51.68 248.25,52.19 ; 305.83,10.19 305.83,24.82 299.86,30.79 299.86,33.77 296.08,37.56 291,37.56 289.47,39.09 ; 446.45,408.06 446.45,408.56 450.64,412.75 450.64,429.24 ; 178.19,439.25 178.19,440.97 ; 178.19,439.25 178.19,410.8 180.44,408.55 180.44,408.04 ; 178.19,439.25 178.18,443.5 173.63,448.04 170.88,448.04 169.86,449.05 169.86,466.1 173.07,469.31 173.07,469.87 ; 446.43,38.79 448.37,36.84 453.45,36.84 456.82,33.48 456.82,28.95 460.95,24.82 460.95,10.19 ; 296.11,427.87 296.11,410.13 297.72,408.52 U1.43 ; v2(71.02,469.88) 71.02,441.99 69.64,440.61 69.64,433.78 67.59,431.72 62.96,431.72 59.25,428.01 ; 407.11,469.89 407.11,469.33 405.73,467.96 405.73,448.78 407.16,447.35 409.92,447.35 414.05,443.22 414.05,439.27 ; 210.81,52.19 210.81,51.68 209.2,50.07 209.2,38.47 ; 166.59,42.17 164.11,39.69 161.34,39.69 158.24,36.59 158.24,32.86 152.27,26.9 152.27,10.22 ; 166.59,42.17 166.59,47.52 162.41,51.71 162.41,52.21 ; 166.59,42.17 166.6,42.18 ; 408.38,469.89 408.38,469.33 406.09,467.04 406.09,448.93 407.31,447.7 410.07,447.7 414.4,443.37 414.41,439.27 ; U4.69 281.66,51.71 285.2,48.17 285.2,37.32 ; 131.43,38.94 131.43,48.17 134.97,51.71 v1(134.97,52.21) ; 135.22,429.22 140.6,434.6 145.22,434.6 145.61,434.99 145.61,436.05 139.65,442.02 139.65,469.9 ; 211.7,10.16 211.7,24.8 216.75,29.84 216.75,31.97 215.47,33.26 210.38,33.26 206.35,37.29 ; 178.9,439.25 178.9,440.97 ; 178.9,439.25 178.89,443.79 173.93,448.75 171.17,448.75 170.57,449.35 170.57,464.27 175.62,469.31 175.62,469.87 ; 178.9,439.25 178.9,412.09 182.44,408.55 182.44,408.04 ; 218.36,427.43 218.36,412.06 221.9,408.52 U1.101 ; 295.4,428.16 299.31,432.08 303.94,432.08 305.79,433.93 305.79,441.53 306.25,441.99 306.25,469.88 ; 400.74,469.89 400.74,469.33 403.95,466.12 403.95,448.04 406.42,445.57 409.18,445.57 